# EAGLE schematic Resistor_Resistor (EAGLE 8.3.0), part 27 of 43
## Parts (continued)
R37218  10K  RESISTOR_0201  [0201]
R37219  10K  RESISTOR_0201  [0201]
R37220  10K  RESISTOR_0201  [0201]
R37221  10K  RESISTOR_0201  [0201]
R37222  10K  RESISTOR_0201  [0201]
R37223  10K  RESISTOR_0201  [0201]
R37224  10K  RESISTOR_0201  [0201]
R37225  10K  RESISTOR_0201  [0201]
R37226  10K  RESISTOR_0201  [0201]
R37227  10K  RESISTOR_0201  [0201]
R37228  10K  RESISTOR_0201  [0201]
R37229  10K  RESISTOR_0201  [0201]
R37230  10K  RESISTOR_0201  [0201]
R37231  10K  RESISTOR_0201  [0201]
R37232  10K  RESISTOR_0201  [0201]
R37233  10K  RESISTOR_0201  [0201]
R37234  10K  RESISTOR_0201  [0201]
R37235  10K  RESISTOR_0201  [0201]
R37236  10K  RESISTOR_0201  [0201]
R37237  10K  RESISTOR_0201  [0201]
R37238  10K  RESISTOR_0201  [0201]
R37239  10K  RESISTOR_0201  [0201]
R37240  10K  RESISTOR_0201  [0201]
R37241  10K  RESISTOR_0201  [0201]
R37242  10K  RESISTOR_0201  [0201]
R37243  10K  RESISTOR_0201  [0201]
R37244  10K  RESISTOR_0201  [0201]
R37245  10K  RESISTOR_0201  [0201]
R37246  10K  RESISTOR_0201  [0201]
R37247  10K  RESISTOR_0201  [0201]
R37248  10K  RESISTOR_0201  [0201]
R37249  10K  RESISTOR_0201  [0201]
R37250  10K  RESISTOR_0201  [0201]
R37251  10K  RESISTOR_0201  [0201]
R37252  10K  RESISTOR_0201  [0201]
R37253  10K  RESISTOR_0201  [0201]
R37254  10K  RESISTOR_0201  [0201]
R37255  10K  RESISTOR_0201  [0201]
R37256  10K  RESISTOR_0201  [0201]
R37257  10K  RESISTOR_0201  [0201]
R37258  10K  RESISTOR_0201  [0201]
R37259  10K  RESISTOR_0201  [0201]
R37260  10K  RESISTOR_0201  [0201]
R37261  10K  RESISTOR_0201  [0201]
R37262  10K  RESISTOR_0201  [0201]
R37263  10K  RESISTOR_0201  [0201]
R37264  10K  RESISTOR_0201  [0201]
R37265  10K  RESISTOR_0201  [0201]
R37266  10K  RESISTOR_0201  [0201]
R37267  10K  RESISTOR_0201  [0201]
R37268  10K  RESISTOR_0201  [0201]
R37269  10K  RESISTOR_0201  [0201]
R37270  10K  RESISTOR_0201  [0201]
R37271  10K  RESISTOR_0201  [0201]
R37272  10K  RESISTOR_0201  [0201]
R37273  10K  RESISTOR_0201  [0201]
R37274  10K  RESISTOR_0201  [0201]
R37275  10K  RESISTOR_0201  [0201]
R37276  10K  RESISTOR_0201  [0201]
R37277  10K  RESISTOR_0201  [0201]
R37278  10K  RESISTOR_0201  [0201]
R37279  10K  RESISTOR_0201  [0201]
R37280  10K  RESISTOR_0201  [0201]
R37281  10K  RESISTOR_0201  [0201]
R37282  10K  RESISTOR_0201  [0201]
R37283  10K  RESISTOR_0201  [0201]
R37284  10K  RESISTOR_0201  [0201]
R37285  10K  RESISTOR_0201  [0201]
R37286  10K  RESISTOR_0201  [0201]
R37287  10K  RESISTOR_0201  [0201]
R37288  10K  RESISTOR_0201  [0201]
R37289  10K  RESISTOR_0201  [0201]
R37290  10K  RESISTOR_0201  [0201]
R37291  10K  RESISTOR_0201  [0201]
R37292  10K  RESISTOR_0201  [0201]
R37293  10K  RESISTOR_0201  [0201]
R37294  10K  RESISTOR_0201  [0201]
R37295  10K  RESISTOR_0201  [0201]
R37296  10K  RESISTOR_0201  [0201]
R37297  10K  RESISTOR_0201  [0201]
R37298  10K  RESISTOR_0201  [0201]
R37299  10K  RESISTOR_0201  [0201]
R37300  10K  RESISTOR_0201  [0201]
R37301  10K  RESISTOR_0201  [0201]
R37302  10K  RESISTOR_0201  [0201]
R37303  10K  RESISTOR_0201  [0201]
R37304  10K  RESISTOR_0201  [0201]
R37305  10K  RESISTOR_0201  [0201]
R37306  10K  RESISTOR_0201  [0201]
R37307  10K  RESISTOR_0201  [0201]
R37308  10K  RESISTOR_0201  [0201]
R37309  10K  RESISTOR_0201  [0201]
R37310  10K  RESISTOR_0201  [0201]
R37311  10K  RESISTOR_0201  [0201]
R37312  10K  RESISTOR_0201  [0201]
R37313  10K  RESISTOR_0201  [0201]
R37314  10K  RESISTOR_0201  [0201]
R37315  10K  RESISTOR_0201  [0201]
R37316  10K  RESISTOR_0201  [0201]
R37317  10K  RESISTOR_0201  [0201]
R37318  10K  RESISTOR_0201  [0201]
R37319  10K  RESISTOR_0201  [0201]
R37320  10K  RESISTOR_0201  [0201]
R37321  10K  RESISTOR_0201  [0201]
R37322  10K  RESISTOR_0201  [0201]
R37323  10K  RESISTOR_0201  [0201]
R37324  10K  RESISTOR_0201  [0201]
R37325  10K  RESISTOR_0201  [0201]
R37326  10K  RESISTOR_0201  [0201]
R37327  10K  RESISTOR_0201  [0201]
R37328  10K  RESISTOR_0201  [0201]
R37329  10K  RESISTOR_0201  [0201]
R37330  10K  RESISTOR_0201  [0201]
R37331  10K  RESISTOR_0201  [0201]
R37332  10K  RESISTOR_0201  [0201]
R37333  10K  RESISTOR_0201  [0201]
R37334  10K  RESISTOR_0201  [0201]
R37335  10K  RESISTOR_0201  [0201]
R37336  10K  RESISTOR_0201  [0201]
R37337  10K  RESISTOR_0201  [0201]
R37338  10K  RESISTOR_0201  [0201]
R37339  10K  RESISTOR_0201  [0201]
R37340  10K  RESISTOR_0201  [0201]
R37341  10K  RESISTOR_0201  [0201]
R37342  10K  RESISTOR_0201  [0201]
R37343  10K  RESISTOR_0201  [0201]
R37344  10K  RESISTOR_0201  [0201]
R37345  10K  RESISTOR_0201  [0201]
R37346  10K  RESISTOR_0201  [0201]
R37347  10K  RESISTOR_0201  [0201]
R37348  10K  RESISTOR_0201  [0201]
R37349  10K  RESISTOR_0201  [0201]
R37350  10K  RESISTOR_0201  [0201]
R37351  10K  RESISTOR_0201  [0201]
R37352  10K  RESISTOR_0201  [0201]
R37353  10K  RESISTOR_0201  [0201]
R37354  10K  RESISTOR_0201  [0201]
R37355  10K  RESISTOR_0201  [0201]
R37356  10K  RESISTOR_0201  [0201]
R37357  10K  RESISTOR_0201  [0201]
R37358  10K  RESISTOR_0201  [0201]
R37359  10K  RESISTOR_0201  [0201]
R37360  10K  RESISTOR_0201  [0201]
R37361  10K  RESISTOR_0201  [0201]
R37362  10K  RESISTOR_0201  [0201]
R37363  10K  RESISTOR_0201  [0201]
R37364  10K  RESISTOR_0201  [0201]
R37365  10K  RESISTOR_0201  [0201]
R37366  10K  RESISTOR_0201  [0201]
R37367  10K  RESISTOR_0201  [0201]
R37368  10K  RESISTOR_0201  [0201]
R37369  10K  RESISTOR_0201  [0201]
R37370  10K  RESISTOR_0201  [0201]
R37371  10K  RESISTOR_0201  [0201]
R37372  10K  RESISTOR_0201  [0201]
R37373  10K  RESISTOR_0201  [0201]
R37374  10K  RESISTOR_0201  [0201]
R37375  10K  RESISTOR_0201  [0201]
R37376  10K  RESISTOR_0201  [0201]
R37377  10K  RESISTOR_0201  [0201]
R37378  10K  RESISTOR_0201  [0201]
R37379  10K  RESISTOR_0201  [0201]
R37380  10K  RESISTOR_0201  [0201]
R37381  10K  RESISTOR_0201  [0201]
R37382  10K  RESISTOR_0201  [0201]
R37383  10K  RESISTOR_0201  [0201]
R37384  10K  RESISTOR_0201  [0201]
R37385  10K  RESISTOR_0201  [0201]
R37386  10K  RESISTOR_0201  [0201]
R37387  10K  RESISTOR_0201  [0201]
R37388  10K  RESISTOR_0201  [0201]
R37389  10K  RESISTOR_0201  [0201]
R37390  10K  RESISTOR_0201  [0201]
R37391  10K  RESISTOR_0201  [0201]
R37392  10K  RESISTOR_0201  [0201]
R37393  10K  RESISTOR_0201  [0201]
R37394  10K  RESISTOR_0201  [0201]
R37395  10K  RESISTOR_0201  [0201]
R37396  10K  RESISTOR_0201  [0201]
R37397  10K  RESISTOR_0201  [0201]
R37398  10K  RESISTOR_0201  [0201]
R37399  10K  RESISTOR_0201  [0201]
R37400  10K  RESISTOR_0201  [0201]
R37401  10K  RESISTOR_0201  [0201]
R37402  10K  RESISTOR_0201  [0201]
R37403  10K  RESISTOR_0201  [0201]
R37404  10K  RESISTOR_0201  [0201]
R37405  10K  RESISTOR_0201  [0201]
R37406  10K  RESISTOR_0201  [0201]
R37407  10K  RESISTOR_0201  [0201]
R37408  10K  RESISTOR_0201  [0201]
R37409  10K  RESISTOR_0201  [0201]
R37410  10K  RESISTOR_0201  [0201]
R37411  10K  RESISTOR_0201  [0201]
R37412  10K  RESISTOR_0201  [0201]
R37413  10K  RESISTOR_0201  [0201]
R37414  10K  RESISTOR_0201  [0201]
R37415  10K  RESISTOR_0201  [0201]
R37416  10K  RESISTOR_0201  [0201]
R37417  10K  RESISTOR_0201  [0201]
R37418  10K  RESISTOR_0201  [0201]
R37419  10K  RESISTOR_0201  [0201]
R37420  10K  RESISTOR_0201  [0201]
R37421  10K  RESISTOR_0201  [0201]
R37422  10K  RESISTOR_0201  [0201]
R37423  10K  RESISTOR_0201  [0201]
R37424  10K  RESISTOR_0201  [0201]
R37425  10K  RESISTOR_0201  [0201]
R37426  10K  RESISTOR_0201  [0201]
R37427  10K  RESISTOR_0201  [0201]
R37428  10K  RESISTOR_0201  [0201]
R37429  10K  RESISTOR_0201  [0201]
R37430  10K  RESISTOR_0201  [0201]
R37431  10K  RESISTOR_0201  [0201]
R37432  10K  RESISTOR_0201  [0201]
R37433  10K  RESISTOR_0201  [0201]
R37434  10K  RESISTOR_0201  [0201]
R37435  10K  RESISTOR_0201  [0201]
R37436  10K  RESISTOR_0201  [0201]
R37437  10K  RESISTOR_0201  [0201]
R37438  10K  RESISTOR_0201  [0201]
R37439  10K  RESISTOR_0201  [0201]
R37440  10K  RESISTOR_0201  [0201]
R37441  10K  RESISTOR_0201  [0201]
R37442  10K  RESISTOR_0201  [0201]
R37443  10K  RESISTOR_0201  [0201]
R37444  10K  RESISTOR_0201  [0201]
R37445  10K  RESISTOR_0201  [0201]
R37446  10K  RESISTOR_0201  [0201]
R37447  10K  RESISTOR_0201  [0201]
R37448  10K  RESISTOR_0201  [0201]
R37449  10K  RESISTOR_0201  [0201]
R37450  10K  RESISTOR_0201  [0201]
R37451  10K  RESISTOR_0201  [0201]
R37452  10K  RESISTOR_0201  [0201]
R37453  10K  RESISTOR_0201  [0201]
R37454  10K  RESISTOR_0201  [0201]
R37455  10K  RESISTOR_0201  [0201]
R37456  10K  RESISTOR_0201  [0201]
R37457  10K  RESISTOR_0201  [0201]
R37458  10K  RESISTOR_0201  [0201]
R37459  10K  RESISTOR_0201  [0201]
R37460  10K  RESISTOR_0201  [0201]
R37461  10K  RESISTOR_0201  [0201]
R37462  10K  RESISTOR_0201  [0201]
R37463  10K  RESISTOR_0201  [0201]
R37464  10K  RESISTOR_0201  [0201]
R37465  10K  RESISTOR_0201  [0201]
R37466  10K  RESISTOR_0201  [0201]
R37467  10K  RESISTOR_0201  [0201]
R37468  10K  RESISTOR_0201  [0201]
R37469  10K  RESISTOR_0201  [0201]
R37470  10K  RESISTOR_0201  [0201]
R37471  10K  RESISTOR_0201  [0201]
R37472  10K  RESISTOR_0201  [0201]
R37473  10K  RESISTOR_0201  [0201]
R37474  10K  RESISTOR_0201  [0201]
R37475  10K  RESISTOR_0201  [0201]
R37476  10K  RESISTOR_0201  [0201]
R37477  10K  RESISTOR_0201  [0201]
R37478  10K  RESISTOR_0201  [0201]
R37479  10K  RESISTOR_0201  [0201]
R37480  10K  RESISTOR_0201  [0201]
R37481  10K  RESISTOR_0201  [0201]
R37482  10K  RESISTOR_0201  [0201]
R37483  10K  RESISTOR_0201  [0201]
R37484  10K  RESISTOR_0201  [0201]
R37485  10K  RESISTOR_0201  [0201]
R37486  10K  RESISTOR_0201  [0201]
R37487  10K  RESISTOR_0201  [0201]
R37488  10K  RESISTOR_0201  [0201]
R37489  10K  RESISTOR_0201  [0201]
R37490  10K  RESISTOR_0201  [0201]
R37491  10K  RESISTOR_0201  [0201]
R37492  10K  RESISTOR_0201  [0201]
R37493  10K  RESISTOR_0201  [0201]
R37494  10K  RESISTOR_0201  [0201]
R37495  10K  RESISTOR_0201  [0201]
R37496  10K  RESISTOR_0201  [0201]
R37497  10K  RESISTOR_0201  [0201]
R37498  10K  RESISTOR_0201  [0201]
R37499  10K  RESISTOR_0201  [0201]
R37500  10K  RESISTOR_0201  [0201]
R37501  10K  RESISTOR_0201  [0201]
R37502  10K  RESISTOR_0201  [0201]
R37503  10K  RESISTOR_0201  [0201]
R37504  10K  RESISTOR_0201  [0201]
R37505  10K  RESISTOR_0201  [0201]
R37506  10K  RESISTOR_0201  [0201]
R37507  10K  RESISTOR_0201  [0201]
R37508  10K  RESISTOR_0201  [0201]
R37509  10K  RESISTOR_0201  [0201]
R37510  10K  RESISTOR_0201  [0201]
R37511  10K  RESISTOR_0201  [0201]
R37512  10K  RESISTOR_0201  [0201]
R37513  10K  RESISTOR_0201  [0201]
R37514  10K  RESISTOR_0201  [0201]
R37515  10K  RESISTOR_0201  [0201]
R37516  10K  RESISTOR_0201  [0201]
R37517  10K  RESISTOR_0201  [0201]
R37518  10K  RESISTOR_0201  [0201]
R37519  10K  RESISTOR_0201  [0201]
R37520  10K  RESISTOR_0201  [0201]
R37521  10K  RESISTOR_0201  [0201]
R37522  10K  RESISTOR_0201  [0201]
R37523  10K  RESISTOR_0201  [0201]
R37524  10K  RESISTOR_0201  [0201]
R37525  10K  RESISTOR_0201  [0201]
R37526  10K  RESISTOR_0201  [0201]
R37527  10K  RESISTOR_0201  [0201]
R37528  10K  RESISTOR_0201  [0201]
R37529  10K  RESISTOR_0201  [0201]
R37530  10K  RESISTOR_0201  [0201]
R37531  10K  RESISTOR_0201  [0201]
R37532  10K  RESISTOR_0201  [0201]
R37533  10K  RESISTOR_0201  [0201]
R37534  10K  RESISTOR_0201  [0201]
R37535  10K  RESISTOR_0201  [0201]
R37536  10K  RESISTOR_0201  [0201]
R37537  10K  RESISTOR_0201  [0201]
R37538  10K  RESISTOR_0201  [0201]
R37539  10K  RESISTOR_0201  [0201]
R37540  10K  RESISTOR_0201  [0201]
R37541  10K  RESISTOR_0201  [0201]
R37542  10K  RESISTOR_0201  [0201]
R37543  10K  RESISTOR_0201  [0201]
R37544  10K  RESISTOR_0201  [0201]
R37545  10K  RESISTOR_0201  [0201]
R37546  10K  RESISTOR_0201  [0201]
R37547  10K  RESISTOR_0201  [0201]
R37548  10K  RESISTOR_0201  [0201]
R37549  10K  RESISTOR_0201  [0201]
R37550  10K  RESISTOR_0201  [0201]
R37551  10K  RESISTOR_0201  [0201]
R37552  10K  RESISTOR_0201  [0201]
R37553  10K  RESISTOR_0201  [0201]
R37554  10K  RESISTOR_0201  [0201]
R37555  10K  RESISTOR_0201  [0201]
R37556  10K  RESISTOR_0201  [0201]
R37557  10K  RESISTOR_0201  [0201]
R37558  10K  RESISTOR_0201  [0201]
R37559  10K  RESISTOR_0201  [0201]
R37560  10K  RESISTOR_0201  [0201]
R37561  10K  RESISTOR_0201  [0201]
R37562  10K  RESISTOR_0201  [0201]
R37563  10K  RESISTOR_0201  [0201]
R37564  10K  RESISTOR_0201  [0201]
R37565  10K  RESISTOR_0201  [0201]
R37566  10K  RESISTOR_0201  [0201]
R37567  10K  RESISTOR_0201  [0201]
R37568  10K  RESISTOR_0201  [0201]
R37569  10K  RESISTOR_0201  [0201]
R37570  10K  RESISTOR_0201  [0201]
R37571  10K  RESISTOR_0201  [0201]
R37572  10K  RESISTOR_0201  [0201]
R37573  10K  RESISTOR_0201  [0201]
R37574  10K  RESISTOR_0201  [0201]
R37575  10K  RESISTOR_0201  [0201]
R37576  10K  RESISTOR_0201  [0201]
R37577  10K  RESISTOR_0201  [0201]
R37578  10K  RESISTOR_0201  [0201]
R37579  10K  RESISTOR_0201  [0201]
R37580  10K  RESISTOR_0201  [0201]
R37581  10K  RESISTOR_0201  [0201]
R37582  10K  RESISTOR_0201  [0201]
R37583  10K  RESISTOR_0201  [0201]
R37584  10K  RESISTOR_0201  [0201]
R37585  10K  RESISTOR_0201  [0201]
R37586  10K  RESISTOR_0201  [0201]
R37587  10K  RESISTOR_0201  [0201]
R37588  10K  RESISTOR_0201  [0201]
R37589  10K  RESISTOR_0201  [0201]
R37590  10K  RESISTOR_0201  [0201]
R37591  10K  RESISTOR_0201  [0201]
R37592  10K  RESISTOR_0201  [0201]
R37593  10K  RESISTOR_0201  [0201]
R37594  10K  RESISTOR_0201  [0201]
R37595  10K  RESISTOR_0201  [0201]
R37596  10K  RESISTOR_0201  [0201]
R37597  10K  RESISTOR_0201  [0201]
R37598  10K  RESISTOR_0201  [0201]
R37599  10K  RESISTOR_0201  [0201]
R37600  10K  RESISTOR_0201  [0201]
R37601  10K  RESISTOR_0201  [0201]
R37602  10K  RESISTOR_0201  [0201]
R37603  10K  RESISTOR_0201  [0201]
R37604  10K  RESISTOR_0201  [0201]
R37605  10K  RESISTOR_0201  [0201]
R37606  10K  RESISTOR_0201  [0201]
R37607  10K  RESISTOR_0201  [0201]
R37608  10K  RESISTOR_0201  [0201]
R37609  10K  RESISTOR_0201  [0201]
R37610  10K  RESISTOR_0201  [0201]
R37611  10K  RESISTOR_0201  [0201]
R37612  10K  RESISTOR_0201  [0201]
R37613  10K  RESISTOR_0201  [0201]
R37614  10K  RESISTOR_0201  [0201]
R37615  10K  RESISTOR_0201  [0201]
R37616  10K  RESISTOR_0201  [0201]
R37617  10K  RESISTOR_0201  [0201]
R37618  10K  RESISTOR_0201  [0201]
R37619  10K  RESISTOR_0201  [0201]
R37620  10K  RESISTOR_0201  [0201]
R37621  10K  RESISTOR_0201  [0201]
R37622  10K  RESISTOR_0201  [0201]
R37623  10K  RESISTOR_0201  [0201]
R37624  10K  RESISTOR_0201  [0201]
R37625  10K  RESISTOR_0201  [0201]
R37626  10K  RESISTOR_0201  [0201]
R37627  10K  RESISTOR_0201  [0201]
R37628  10K  RESISTOR_0201  [0201]
R37629  10K  RESISTOR_0201  [0201]
R37630  10K  RESISTOR_0201  [0201]
R37631  10K  RESISTOR_0201  [0201]
R37632  10K  RESISTOR_0201  [0201]
R37633  10K  RESISTOR_0201  [0201]
R37634  10K  RESISTOR_0201  [0201]
R37635  10K  RESISTOR_0201  [0201]
R37636  10K  RESISTOR_0201  [0201]
R37637  10K  RESISTOR_0201  [0201]
R37638  10K  RESISTOR_0201  [0201]
R37639  10K  RESISTOR_0201  [0201]
R37640  10K  RESISTOR_0201  [0201]
R37641  10K  RESISTOR_0201  [0201]
R37642  10K  RESISTOR_0201  [0201]
R37643  10K  RESISTOR_0201  [0201]
R37644  10K  RESISTOR_0201  [0201]
R37645  10K  RESISTOR_0201  [0201]
R37646  10K  RESISTOR_0201  [0201]
R37647  10K  RESISTOR_0201  [0201]
R37648  10K  RESISTOR_0201  [0201]
R37649  10K  RESISTOR_0201  [0201]
R37650  10K  RESISTOR_0201  [0201]
R37651  10K  RESISTOR_0201  [0201]
R37652  10K  RESISTOR_0201  [0201]
R37653  10K  RESISTOR_0201  [0201]
R37654  10K  RESISTOR_0201  [0201]
R37655  10K  RESISTOR_0201  [0201]
R37656  10K  RESISTOR_0201  [0201]
R37657  10K  RESISTOR_0201  [0201]
R37658  10K  RESISTOR_0201  [0201]
R37659  10K  RESISTOR_0201  [0201]
R37660  10K  RESISTOR_0201  [0201]
R37661  10K  RESISTOR_0201  [0201]
R37662  10K  RESISTOR_0201  [0201]
R37663  10K  RESISTOR_0201  [0201]
R37664  10K  RESISTOR_0201  [0201]
R37665  10K  RESISTOR_0201  [0201]
R37666  10K  RESISTOR_0201  [0201]
R37667  10K  RESISTOR_0201  [0201]
R37668  10K  RESISTOR_0201  [0201]
R37669  10K  RESISTOR_0201  [0201]
R37670  10K  RESISTOR_0201  [0201]
R37671  10K  RESISTOR_0201  [0201]
R37672  10K  RESISTOR_0201  [0201]
R37673  10K  RESISTOR_0201  [0201]
R37674  10K  RESISTOR_0201  [0201]
R37675  10K  RESISTOR_0201  [0201]
R37676  10K  RESISTOR_0201  [0201]
R37677  10K  RESISTOR_0201  [0201]
R37678  10K  RESISTOR_0201  [0201]
R37679  10K  RESISTOR_0201  [0201]
R37680  10K  RESISTOR_0201  [0201]
R37681  10K  RESISTOR_0201  [0201]
R37682  10K  RESISTOR_0201  [0201]
R37683  10K  RESISTOR_0201  [0201]
R37684  10K  RESISTOR_0201  [0201]
R37685  10K  RESISTOR_0201  [0201]
R37686  10K  RESISTOR_0201  [0201]
R37687  10K  RESISTOR_0201  [0201]
R37688  10K  RESISTOR_0201  [0201]
R37689  10K  RESISTOR_0201  [0201]
R37690  10K  RESISTOR_0201  [0201]
R37691  10K  RESISTOR_0201  [0201]
R37692  10K  RESISTOR_0201  [0201]
R37693  10K  RESISTOR_0201  [0201]
R37694  10K  RESISTOR_0201  [0201]
R37695  10K  RESISTOR_0201  [0201]
R37696  10K  RESISTOR_0201  [0201]
R37697  10K  RESISTOR_0201  [0201]
R37698  10K  RESISTOR_0201  [0201]
R37699  10K  RESISTOR_0201  [0201]
R37700  10K  RESISTOR_0201  [0201]
R37701  10K  RESISTOR_0201  [0201]
R37702  10K  RESISTOR_0201  [0201]
R37703  10K  RESISTOR_0201  [0201]
R37704  10K  RESISTOR_0201  [0201]
R37705  10K  RESISTOR_0201  [0201]
R37706  10K  RESISTOR_0201  [0201]
R37707  10K  RESISTOR_0201  [0201]
R37708  10K  RESISTOR_0201  [0201]
R37709  10K  RESISTOR_0201  [0201]
R37710  10K  RESISTOR_0201  [0201]
R37711  10K  RESISTOR_0201  [0201]
R37712  10K  RESISTOR_0201  [0201]
R37713  10K  RESISTOR_0201  [0201]
R37714  10K  RESISTOR_0201  [0201]
R37715  10K  RESISTOR_0201  [0201]
R37716  10K  RESISTOR_0201  [0201]
R37717  10K  RESISTOR_0201  [0201]
R37718  10K  RESISTOR_0201  [0201]
R37719  10K  RESISTOR_0201  [0201]
R37720  10K  RESISTOR_0201  [0201]
R37721  10K  RESISTOR_0201  [0201]
R37722  10K  RESISTOR_0201  [0201]
R37723  10K  RESISTOR_0201  [0201]
R37724  10K  RESISTOR_0201  [0201]
R37725  10K  RESISTOR_0201  [0201]
R37726  10K  RESISTOR_0201  [0201]
R37727  10K  RESISTOR_0201  [0201]
R37728  10K  RESISTOR_0201  [0201]
R37729  10K  RESISTOR_0201  [0201]
R37730  10K  RESISTOR_0201  [0201]
R37731  10K  RESISTOR_0201  [0201]
R37732  10K  RESISTOR_0201  [0201]
R37733  10K  RESISTOR_0201  [0201]
R37734  10K  RESISTOR_0201  [0201]
R37735  10K  RESISTOR_0201  [0201]
R37736  10K  RESISTOR_0201  [0201]
R37737  10K  RESISTOR_0201  [0201]
R37738  10K  RESISTOR_0201  [0201]
R37739  10K  RESISTOR_0201  [0201]
R37740  10K  RESISTOR_0201  [0201]
R37741  10K  RESISTOR_0201  [0201]
R37742  10K  RESISTOR_0201  [0201]
R37743  10K  RESISTOR_0201  [0201]
R37744  10K  RESISTOR_0201  [0201]
R37745  10K  RESISTOR_0201  [0201]
R37746  10K  RESISTOR_0201  [0201]
R37747  10K  RESISTOR_0201  [0201]
R37748  10K  RESISTOR_0201  [0201]
R37749  10K  RESISTOR_0201  [0201]
R37750  10K  RESISTOR_0201  [0201]
R37751  10K  RESISTOR_0201  [0201]
R37752  10K  RESISTOR_0201  [0201]
R37753  10K  RESISTOR_0201  [0201]
R37754  10K  RESISTOR_0201  [0201]
R37755  10K  RESISTOR_0201  [0201]
R37756  10K  RESISTOR_0201  [0201]
R37757  10K  RESISTOR_0201  [0201]
R37758  10K  RESISTOR_0201  [0201]
R37759  10K  RESISTOR_0201  [0201]
R37760  10K  RESISTOR_0201  [0201]
R37761  10K  RESISTOR_0201  [0201]
R37762  10K  RESISTOR_0201  [0201]
R37763  10K  RESISTOR_0201  [0201]
R37764  10K  RESISTOR_0201  [0201]
R37765  10K  RESISTOR_0201  [0201]
R37766  10K  RESISTOR_0201  [0201]
R37767  10K  RESISTOR_0201  [0201]
R37768  10K  RESISTOR_0201  [0201]
R37769  10K  RESISTOR_0201  [0201]
R37770  10K  RESISTOR_0201  [0201]
R37771  10K  RESISTOR_0201  [0201]
R37772  10K  RESISTOR_0201  [0201]
R37773  10K  RESISTOR_0201  [0201]
R37774  10K  RESISTOR_0201  [0201]
R37775  10K  RESISTOR_0201  [0201]
R37776  10K  RESISTOR_0201  [0201]
R37777  10K  RESISTOR_0201  [0201]
R37778  10K  RESISTOR_0201  [0201]
R37779  10K  RESISTOR_0201  [0201]
R37780  10K  RESISTOR_0201  [0201]
R37781  10K  RESISTOR_0201  [0201]
R37782  10K  RESISTOR_0201  [0201]
R37783  10K  RESISTOR_0201  [0201]
R37784  10K  RESISTOR_0201  [0201]
R37785  10K  RESISTOR_0201  [0201]
R37786  10K  RESISTOR_0201  [0201]
R37787  10K  RESISTOR_0201  [0201]
R37788  10K  RESISTOR_0201  [0201]
R37789  10K  RESISTOR_0201  [0201]
R37790  10K  RESISTOR_0201  [0201]
R37791  10K  RESISTOR_0201  [0201]
R37792  10K  RESISTOR_0201  [0201]
R37793  10K  RESISTOR_0201  [0201]
R37794  10K  RESISTOR_0201  [0201]
R37795  10K  RESISTOR_0201  [0201]
R37796  10K  RESISTOR_0201  [0201]
R37797  10K  RESISTOR_0201  [0201]
R37798  10K  RESISTOR_0201  [0201]
R37799  10K  RESISTOR_0201  [0201]
R37800  10K  RESISTOR_0201  [0201]
R37801  10K  RESISTOR_0201  [0201]
R37802  10K  RESISTOR_0201  [0201]
R37803  10K  RESISTOR_0201  [0201]
R37804  10K  RESISTOR_0201  [0201]
R37805  10K  RESISTOR_0201  [0201]
R37806  10K  RESISTOR_0201  [0201]
R37807  10K  RESISTOR_0201  [0201]
R37808  10K  RESISTOR_0201  [0201]
R37809  10K  RESISTOR_0201  [0201]
R37810  10K  RESISTOR_0201  [0201]
R37811  10K  RESISTOR_0201  [0201]
R37812  10K  RESISTOR_0201  [0201]
R37813  10K  RESISTOR_0201  [0201]
R37814  10K  RESISTOR_0201  [0201]
R37815  10K  RESISTOR_0201  [0201]
R37816  10K  RESISTOR_0201  [0201]
R37817  10K  RESISTOR_0201  [0201]
R37818  10K  RESISTOR_0201  [0201]
R37819  10K  RESISTOR_0201  [0201]
R37820  10K  RESISTOR_0201  [0201]
R37821  10K  RESISTOR_0201  [0201]
R37822  10K  RESISTOR_0201  [0201]
R37823  10K  RESISTOR_0201  [0201]
R37824  10K  RESISTOR_0201  [0201]
R37825  10K  RESISTOR_0201  [0201]
R37826  10K  RESISTOR_0201  [0201]
R37827  10K  RESISTOR_0201  [0201]
R37828  10K  RESISTOR_0201  [0201]
R37829  10K  RESISTOR_0201  [0201]
R37830  10K  RESISTOR_0201  [0201]
R37831  10K  RESISTOR_0201  [0201]
R37832  10K  RESISTOR_0201  [0201]
R37833  10K  RESISTOR_0201  [0201]
R37834  10K  RESISTOR_0201  [0201]
R37835  10K  RESISTOR_0201  [0201]
R37836  10K  RESISTOR_0201  [0201]
R37837  10K  RESISTOR_0201  [0201]
R37838  10K  RESISTOR_0201  [0201]
R37839  10K  RESISTOR_0201  [0201]
R37840  10K  RESISTOR_0201  [0201]
R37841  10K  RESISTOR_0201  [0201]
R37842  10K  RESISTOR_0201  [0201]
R37843  10K  RESISTOR_0201  [0201]
R37844  10K  RESISTOR_0201  [0201]
R37845  10K  RESISTOR_0201  [0201]
R37846  10K  RESISTOR_0201  [0201]
R37847  10K  RESISTOR_0201  [0201]
R37848  10K  RESISTOR_0201  [0201]
R37849  10K  RESISTOR_0201  [0201]
R37850  10K  RESISTOR_0201  [0201]
R37851  10K  RESISTOR_0201  [0201]
R37852  10K  RESISTOR_0201  [0201]
R37853  10K  RESISTOR_0201  [0201]
R37854  10K  RESISTOR_0201  [0201]
R37855  10K  RESISTOR_0201  [0201]
R37856  10K  RESISTOR_0201  [0201]
R37857  10K  RESISTOR_0201  [0201]
R37858  10K  RESISTOR_0201  [0201]
R37859  10K  RESISTOR_0201  [0201]
R37860  10K  RESISTOR_0201  [0201]
R37861  10K  RESISTOR_0201  [0201]
R37862  10K  RESISTOR_0201  [0201]
R37863  10K  RESISTOR_0201  [0201]
R37864  10K  RESISTOR_0201  [0201]
R37865  10K  RESISTOR_0201  [0201]
R37866  10K  RESISTOR_0201  [0201]
R37867  10K  RESISTOR_0201  [0201]
R37868  10K  RESISTOR_0201  [0201]
R37869  10K  RESISTOR_0201  [0201]
R37870  10K  RESISTOR_0201  [0201]
R37871  10K  RESISTOR_0201  [0201]
R37872  10K  RESISTOR_0201  [0201]
R37873  10K  RESISTOR_0201  [0201]
R37874  10K  RESISTOR_0201  [0201]
R37875  10K  RESISTOR_0201  [0201]
R37876  10K  RESISTOR_0201  [0201]
R37877  10K  RESISTOR_0201  [0201]
R37878  10K  RESISTOR_0201  [0201]
R37879  10K  RESISTOR_0201  [0201]
R37880  10K  RESISTOR_0201  [0201]
R37881  10K  RESISTOR_0201  [0201]
R37882  10K  RESISTOR_0201  [0201]
R37883  10K  RESISTOR_0201  [0201]
R37884  10K  RESISTOR_0201  [0201]
R37885  10K  RESISTOR_0201  [0201]
R37886  10K  RESISTOR_0201  [0201]
R37887  10K  RESISTOR_0201  [0201]
R37888  10K  RESISTOR_0201  [0201]
R37889  10K  RESISTOR_0201  [0201]
R37890  10K  RESISTOR_0201  [0201]
R37891  10K  RESISTOR_0201  [0201]
R37892  10K  RESISTOR_0201  [0201]
R37893  10K  RESISTOR_0201  [0201]
R37894  10K  RESISTOR_0201  [0201]
R37895  10K  RESISTOR_0201  [0201]
R37896  10K  RESISTOR_0201  [0201]
R37897  10K  RESISTOR_0201  [0201]
R37898  10K  RESISTOR_0201  [0201]
R37899  10K  RESISTOR_0201  [0201]
R37900  10K  RESISTOR_0201  [0201]
R37901  10K  RESISTOR_0201  [0201]
R37902  10K  RESISTOR_0201  [0201]
R37903  10K  RESISTOR_0201  [0201]
R37904  10K  RESISTOR_0201  [0201]
R37905  10K  RESISTOR_0201  [0201]
R37906  10K  RESISTOR_0201  [0201]
R37907  10K  RESISTOR_0201  [0201]
R37908  10K  RESISTOR_0201  [0201]
R37909  10K  RESISTOR_0201  [0201]
R37910  10K  RESISTOR_0201  [0201]
R37911  10K  RESISTOR_0201  [0201]
R37912  10K  RESISTOR_0201  [0201]
R37913  10K  RESISTOR_0201  [0201]
R37914  10K  RESISTOR_0201  [0201]
R37915  10K  RESISTOR_0201  [0201]
R37916  10K  RESISTOR_0201  [0201]
R37917  10K  RESISTOR_0201  [0201]
R37918  10K  RESISTOR_0201  [0201]
R37919  10K  RESISTOR_0201  [0201]
R37920  10K  RESISTOR_0201  [0201]
R37921  10K  RESISTOR_0201  [0201]
R37922  10K  RESISTOR_0201  [0201]
R37923  10K  RESISTOR_0201  [0201]
R37924  10K  RESISTOR_0201  [0201]
R37925  10K  RESISTOR_0201  [0201]
R37926  10K  RESISTOR_0201  [0201]
R37927  10K  RESISTOR_0201  [0201]
R37928  10K  RESISTOR_0201  [0201]
R37929  10K  RESISTOR_0201  [0201]
R37930  10K  RESISTOR_0201  [0201]
R37931  10K  RESISTOR_0201  [0201]
R37932  10K  RESISTOR_0201  [0201]
R37933  10K  RESISTOR_0201  [0201]
R37934  10K  RESISTOR_0201  [0201]
R37935  10K  RESISTOR_0201  [0201]
R37936  10K  RESISTOR_0201  [0201]
R37937  10K  RESISTOR_0201  [0201]
R37938  10K  RESISTOR_0201  [0201]
R37939  10K  RESISTOR_0201  [0201]
R37940  10K  RESISTOR_0201  [0201]
R37941  10K  RESISTOR_0201  [0201]
R37942  10K  RESISTOR_0201  [0201]
R37943  10K  RESISTOR_0201  [0201]
R37944  10K  RESISTOR_0201  [0201]
R37945  10K  RESISTOR_0201  [0201]
R37946  10K  RESISTOR_0201  [0201]
R37947  10K  RESISTOR_0201  [0201]
R37948  10K  RESISTOR_0201  [0201]
R37949  10K  RESISTOR_0201  [0201]
R37950  10K  RESISTOR_0201  [0201]
R37951  10K  RESISTOR_0201  [0201]
R37952  10K  RESISTOR_0201  [0201]
R37953  10K  RESISTOR_0201  [0201]
R37954  10K  RESISTOR_0201  [0201]
R37955  10K  RESISTOR_0201  [0201]
R37956  10K  RESISTOR_0201  [0201]
R37957  10K  RESISTOR_0201  [0201]
R37958  10K  RESISTOR_0201  [0201]
R37959  10K  RESISTOR_0201  [0201]
R37960  10K  RESISTOR_0201  [0201]
R37961  10K  RESISTOR_0201  [0201]
R37962  10K  RESISTOR_0201  [0201]
R37963  10K  RESISTOR_0201  [0201]
R37964  10K  RESISTOR_0201  [0201]
R37965  10K  RESISTOR_0201  [0201]
R37966  10K  RESISTOR_0201  [0201]
R37967  10K  RESISTOR_0201  [0201]
R37968  10K  RESISTOR_0201  [0201]
R37969  10K  RESISTOR_0201  [0201]
R37970  10K  RESISTOR_0201  [0201]
R37971  10K  RESISTOR_0201  [0201]
R37972  10K  RESISTOR_0201  [0201]
R37973  10K  RESISTOR_0201  [0201]
R37974  10K  RESISTOR_0201  [0201]
R37975  10K  RESISTOR_0201  [0201]
R37976  10K  RESISTOR_0201  [0201]
R37977  10K  RESISTOR_0201  [0201]
R37978  10K  RESISTOR_0201  [0201]
R37979  10K  RESISTOR_0201  [0201]
R37980  10K  RESISTOR_0201  [0201]
R37981  10K  RESISTOR_0201  [0201]
R37982  10K  RESISTOR_0201  [0201]
R37983  10K  RESISTOR_0201  [0201]
R37984  10K  RESISTOR_0201  [0201]
R37985  10K  RESISTOR_0201  [0201]
R37986  10K  RESISTOR_0201  [0201]
R37987  10K  RESISTOR_0201  [0201]
R37988  10K  RESISTOR_0201  [0201]
R37989  10K  RESISTOR_0201  [0201]
R37990  10K  RESISTOR_0201  [0201]
R37991  10K  RESISTOR_0201  [0201]
R37992  10K  RESISTOR_0201  [0201]
R37993  10K  RESISTOR_0201  [0201]
R37994  10K  RESISTOR_0201  [0201]
R37995  10K  RESISTOR_0201  [0201]
R37996  10K  RESISTOR_0201  [0201]
R37997  10K  RESISTOR_0201  [0201]
R37998  10K  RESISTOR_0201  [0201]
R37999  10K  RESISTOR_0201  [0201]
R38000  10K  RESISTOR_0201  [0201]
R38001  10K  RESISTOR_0201  [0201]
R38002  10K  RESISTOR_0201  [0201]
R38003  10K  RESISTOR_0201  [0201]
R38004  10K  RESISTOR_0201  [0201]
R38005  10K  RESISTOR_0201  [0201]
R38006  10K  RESISTOR_0201  [0201]
R38007  10K  RESISTOR_0201  [0201]
R38008  10K  RESISTOR_0201  [0201]
R38009  10K  RESISTOR_0201  [0201]
R38010  10K  RESISTOR_0201  [0201]
R38011  10K  RESISTOR_0201  [0201]
R38012  10K  RESISTOR_0201  [0201]
R38013  10K  RESISTOR_0201  [0201]
R38014  10K  RESISTOR_0201  [0201]
R38015  10K  RESISTOR_0201  [0201]
R38016  10K  RESISTOR_0201  [0201]
R38017  10K  RESISTOR_0201  [0201]
R38018  10K  RESISTOR_0201  [0201]
R38019  10K  RESISTOR_0201  [0201]
R38020  10K  RESISTOR_0201  [0201]
R38021  10K  RESISTOR_0201  [0201]
R38022  10K  RESISTOR_0201  [0201]
R38023  10K  RESISTOR_0201  [0201]
R38024  10K  RESISTOR_0201  [0201]
R38025  10K  RESISTOR_0201  [0201]
R38026  10K  RESISTOR_0201  [0201]
R38027  10K  RESISTOR_0201  [0201]
R38028  10K  RESISTOR_0201  [0201]
R38029  10K  RESISTOR_0201  [0201]
R38030  10K  RESISTOR_0201  [0201]
R38031  10K  RESISTOR_0201  [0201]
R38032  10K  RESISTOR_0201  [0201]
R38033  10K  RESISTOR_0201  [0201]
R38034  10K  RESISTOR_0201  [0201]
R38035  10K  RESISTOR_0201  [0201]
R38036  10K  RESISTOR_0201  [0201]
R38037  10K  RESISTOR_0201  [0201]
R38038  10K  RESISTOR_0201  [0201]
R38039  10K  RESISTOR_0201  [0201]
R38040  10K  RESISTOR_0201  [0201]
R38041  10K  RESISTOR_0201  [0201]
R38042  10K  RESISTOR_0201  [0201]
R38043  10K  RESISTOR_0201  [0201]
R38044  10K  RESISTOR_0201  [0201]
R38045  10K  RESISTOR_0201  [0201]
R38046  10K  RESISTOR_0201  [0201]
R38047  10K  RESISTOR_0201  [0201]
R38048  10K  RESISTOR_0201  [0201]
R38049  10K  RESISTOR_0201  [0201]
R38050  10K  RESISTOR_0201  [0201]
R38051  10K  RESISTOR_0201  [0201]
R38052  10K  RESISTOR_0201  [0201]
R38053  10K  RESISTOR_0201  [0201]
R38054  10K  RESISTOR_0201  [0201]
R38055  10K  RESISTOR_0201  [0201]
R38056  10K  RESISTOR_0201  [0201]
R38057  10K  RESISTOR_0201  [0201]
R38058  10K  RESISTOR_0201  [0201]
R38059  10K  RESISTOR_0201  [0201]
R38060  10K  RESISTOR_0201  [0201]
R38061  10K  RESISTOR_0201  [0201]
R38062  10K  RESISTOR_0201  [0201]
R38063  10K  RESISTOR_0201  [0201]
R38064  10K  RESISTOR_0201  [0201]
R38065  10K  RESISTOR_0201  [0201]
R38066  10K  RESISTOR_0201  [0201]
R38067  10K  RESISTOR_0201  [0201]
R38068  10K  RESISTOR_0201  [0201]
R38069  10K  RESISTOR_0201  [0201]
R38070  10K  RESISTOR_0201  [0201]
R38071  10K  RESISTOR_0201  [0201]
R38072  10K  RESISTOR_0201  [0201]
R38073  10K  RESISTOR_0201  [0201]
R38074  10K  RESISTOR_0201  [0201]
R38075  10K  RESISTOR_0201  [0201]
R38076  10K  RESISTOR_0201  [0201]
R38077  10K  RESISTOR_0201  [0201]
R38078  10K  RESISTOR_0201  [0201]
R38079  10K  RESISTOR_0201  [0201]
R38080  10K  RESISTOR_0201  [0201]
R38081  10K  RESISTOR_0201  [0201]
R38082  10K  RESISTOR_0201  [0201]
R38083  10K  RESISTOR_0201  [0201]
R38084  10K  RESISTOR_0201  [0201]
R38085  10K  RESISTOR_0201  [0201]
R38086  10K  RESISTOR_0201  [0201]
R38087  10K  RESISTOR_0201  [0201]
R38088  10K  RESISTOR_0201  [0201]
R38089  10K  RESISTOR_0201  [0201]
R38090  10K  RESISTOR_0201  [0201]
R38091  10K  RESISTOR_0201  [0201]
R38092  10K  RESISTOR_0201  [0201]
R38093  10K  RESISTOR_0201  [0201]
R38094  10K  RESISTOR_0201  [0201]
R38095  10K  RESISTOR_0201  [0201]
R38096  10K  RESISTOR_0201  [0201]
R38097  10K  RESISTOR_0201  [0201]
R38098  10K  RESISTOR_0201  [0201]
R38099  10K  RESISTOR_0201  [0201]
R38100  10K  RESISTOR_0201  [0201]
R38101  10K  RESISTOR_0201  [0201]
R38102  10K  RESISTOR_0201  [0201]
R38103  10K  RESISTOR_0201  [0201]
R38104  10K  RESISTOR_0201  [0201]
R38105  10K  RESISTOR_0201  [0201]
R38106  10K  RESISTOR_0201  [0201]
R38107  10K  RESISTOR_0201  [0201]
R38108  10K  RESISTOR_0201  [0201]
R38109  10K  RESISTOR_0201  [0201]
R38110  10K  RESISTOR_0201  [0201]
R38111  10K  RESISTOR_0201  [0201]
R38112  10K  RESISTOR_0201  [0201]
R38113  10K  RESISTOR_0201  [0201]
R38114  10K  RESISTOR_0201  [0201]
R38115  10K  RESISTOR_0201  [0201]
R38116  10K  RESISTOR_0201  [0201]
R38117  10K  RESISTOR_0201  [0201]
R38118  10K  RESISTOR_0201  [0201]
R38119  10K  RESISTOR_0201  [0201]
R38120  10K  RESISTOR_0201  [0201]
R38121  10K  RESISTOR_0201  [0201]
R38122  10K  RESISTOR_0201  [0201]
R38123  10K  RESISTOR_0201  [0201]
R38124  10K  RESISTOR_0201  [0201]
R38125  10K  RESISTOR_0201  [0201]
R38126  10K  RESISTOR_0201  [0201]
R38127  10K  RESISTOR_0201  [0201]
R38128  10K  RESISTOR_0201  [0201]
R38129  10K  RESISTOR_0201  [0201]
R38130  10K  RESISTOR_0201  [0201]
R38131  10K  RESISTOR_0201  [0201]
R38132  10K  RESISTOR_0201  [0201]
R38133  10K  RESISTOR_0201  [0201]
R38134  10K  RESISTOR_0201  [0201]
R38135  10K  RESISTOR_0201  [0201]
R38136  10K  RESISTOR_0201  [0201]
R38137  10K  RESISTOR_0201  [0201]
R38138  10K  RESISTOR_0201  [0201]
R38139  10K  RESISTOR_0201  [0201]
R38140  10K  RESISTOR_0201  [0201]
R38141  10K  RESISTOR_0201  [0201]
R38142  10K  RESISTOR_0201  [0201]
R38143  10K  RESISTOR_0201  [0201]
R38144  10K  RESISTOR_0201  [0201]
R38145  10K  RESISTOR_0201  [0201]
R38146  10K  RESISTOR_0201  [0201]
R38147  10K  RESISTOR_0201  [0201]
R38148  10K  RESISTOR_0201  [0201]
R38149  10K  RESISTOR_0201  [0201]
R38150  10K  RESISTOR_0201  [0201]
R38151  10K  RESISTOR_0201  [0201]
R38152  10K  RESISTOR_0201  [0201]
R38153  10K  RESISTOR_0201  [0201]
R38154  10K  RESISTOR_0201  [0201]
R38155  10K  RESISTOR_0201  [0201]
R38156  10K  RESISTOR_0201  [0201]
R38157  10K  RESISTOR_0201  [0201]
R38158  10K  RESISTOR_0201  [0201]
R38159  10K  RESISTOR_0201  [0201]
R38160  10K  RESISTOR_0201  [0201]
R38161  10K  RESISTOR_0201  [0201]
R38162  10K  RESISTOR_0201  [0201]
R38163  10K  RESISTOR_0201  [0201]
R38164  10K  RESISTOR_0201  [0201]
R38165  10K  RESISTOR_0201  [0201]
R38166  10K  RESISTOR_0201  [0201]
R38167  10K  RESISTOR_0201  [0201]
R38168  10K  RESISTOR_0201  [0201]
R38169  10K  RESISTOR_0201  [0201]
R38170  10K  RESISTOR_0201  [0201]
R38171  10K  RESISTOR_0201  [0201]
R38172  10K  RESISTOR_0201  [0201]
R38173  10K  RESISTOR_0201  [0201]
R38174  10K  RESISTOR_0201  [0201]
R38175  10K  RESISTOR_0201  [0201]
R38176  10K  RESISTOR_0201  [0201]
R38177  10K  RESISTOR_0201  [0201]
R38178  10K  RESISTOR_0201  [0201]
R38179  10K  RESISTOR_0201  [0201]
R38180  10K  RESISTOR_0201  [0201]
R38181  10K  RESISTOR_0201  [0201]
R38182  10K  RESISTOR_0201  [0201]
R38183  10K  RESISTOR_0201  [0201]
R38184  10K  RESISTOR_0201  [0201]
R38185  10K  RESISTOR_0201  [0201]
R38186  10K  RESISTOR_0201  [0201]
R38187  10K  RESISTOR_0201  [0201]
R38188  10K  RESISTOR_0201  [0201]
R38189  10K  RESISTOR_0201  [0201]
R38190  10K  RESISTOR_0201  [0201]
R38191  10K  RESISTOR_0201  [0201]
R38192  10K  RESISTOR_0201  [0201]
R38193  10K  RESISTOR_0201  [0201]
R38194  10K  RESISTOR_0201  [0201]
R38195  10K  RESISTOR_0201  [0201]
R38196  10K  RESISTOR_0201  [0201]
R38197  10K  RESISTOR_0201  [0201]
R38198  10K  RESISTOR_0201  [0201]
R38199  10K  RESISTOR_0201  [0201]
R38200  10K  RESISTOR_0201  [0201]
R38201  10K  RESISTOR_0201  [0201]
R38202  10K  RESISTOR_0201  [0201]
R38203  10K  RESISTOR_0201  [0201]
R38204  10K  RESISTOR_0201  [0201]
R38205  10K  RESISTOR_0201  [0201]
R38206  10K  RESISTOR_0201  [0201]
R38207  10K  RESISTOR_0201  [0201]
R38208  10K  RESISTOR_0201  [0201]
R38209  10K  RESISTOR_0201  [0201]
R38210  10K  RESISTOR_0201  [0201]
R38211  10K  RESISTOR_0201  [0201]
R38212  10K  RESISTOR_0201  [0201]
R38213  10K  RESISTOR_0201  [0201]
R38214  10K  RESISTOR_0201  [0201]
R38215  10K  RESISTOR_0201  [0201]
R38216  10K  RESISTOR_0201  [0201]
R38217  10K  RESISTOR_0201  [0201]
R38218  10K  RESISTOR_0201  [0201]
R38219  10K  RESISTOR_0201  [0201]
R38220  10K  RESISTOR_0201  [0201]
R38221  10K  RESISTOR_0201  [0201]
R38222  10K  RESISTOR_0201  [0201]
R38223  10K  RESISTOR_0201  [0201]
R38224  10K  RESISTOR_0201  [0201]
R38225  10K  RESISTOR_0201  [0201]
R38226  10K  RESISTOR_0201  [0201]
R38227  10K  RESISTOR_0201  [0201]
R38228  10K  RESISTOR_0201  [0201]
R38229  10K  RESISTOR_0201  [0201]
R38230  10K  RESISTOR_0201  [0201]
R38231  10K  RESISTOR_0201  [0201]
R38232  10K  RESISTOR_0201  [0201]
R38233  10K  RESISTOR_0201  [0201]
R38234  10K  RESISTOR_0201  [0201]
R38235  10K  RESISTOR_0201  [0201]
R38236  10K  RESISTOR_0201  [0201]
R38237  10K  RESISTOR_0201  [0201]
R38238  10K  RESISTOR_0201  [0201]
R38239  10K  RESISTOR_0201  [0201]
R38240  10K  RESISTOR_0201  [0201]
R38241  10K  RESISTOR_0201  [0201]
R38242  10K  RESISTOR_0201  [0201]
R38243  10K  RESISTOR_0201  [0201]
R38244  10K  RESISTOR_0201  [0201]
R38245  10K  RESISTOR_0201  [0201]
R38246  10K  RESISTOR_0201  [0201]
R38247  10K  RESISTOR_0201  [0201]
R38248  10K  RESISTOR_0201  [0201]
R38249  10K  RESISTOR_0201  [0201]
R38250  10K  RESISTOR_0201  [0201]
R38251  10K  RESISTOR_0201  [0201]
R38252  10K  RESISTOR_0201  [0201]
R38253  10K  RESISTOR_0201  [0201]
R38254  10K  RESISTOR_0201  [0201]
R38255  10K  RESISTOR_0201  [0201]
R38256  10K  RESISTOR_0201  [0201]
R38257  10K  RESISTOR_0201  [0201]
R38258  10K  RESISTOR_0201  [0201]
R38259  10K  RESISTOR_0201  [0201]
R38260  10K  RESISTOR_0201  [0201]
R38261  10K  RESISTOR_0201  [0201]
R38262  10K  RESISTOR_0201  [0201]
R38263  10K  RESISTOR_0201  [0201]
R38264  10K  RESISTOR_0201  [0201]
R38265  10K  RESISTOR_0201  [0201]
R38266  10K  RESISTOR_0201  [0201]
R38267  10K  RESISTOR_0201  [0201]
R38268  10K  RESISTOR_0201  [0201]
R38269  10K  RESISTOR_0201  [0201]
R38270  10K  RESISTOR_0201  [0201]
R38271  10K  RESISTOR_0201  [0201]
R38272  10K  RESISTOR_0201  [0201]
R38273  10K  RESISTOR_0201  [0201]
R38274  10K  RESISTOR_0201  [0201]
R38275  10K  RESISTOR_0201  [0201]
R38276  10K  RESISTOR_0201  [0201]
R38277  10K  RESISTOR_0201  [0201]
R38278  10K  RESISTOR_0201  [0201]
R38279  10K  RESISTOR_0201  [0201]
R38280  10K  RESISTOR_0201  [0201]
R38281  10K  RESISTOR_0201  [0201]
R38282  10K  RESISTOR_0201  [0201]
R38283  10K  RESISTOR_0201  [0201]
R38284  10K  RESISTOR_0201  [0201]
R38285  10K  RESISTOR_0201  [0201]
R38286  10K  RESISTOR_0201  [0201]
R38287  10K  RESISTOR_0201  [0201]
R38288  10K  RESISTOR_0201  [0201]
R38289  10K  RESISTOR_0201  [0201]
R38290  10K  RESISTOR_0201  [0201]
R38291  10K  RESISTOR_0201  [0201]
R38292  10K  RESISTOR_0201  [0201]
R38293  10K  RESISTOR_0201  [0201]
R38294  10K  RESISTOR_0201  [0201]
R38295  10K  RESISTOR_0201  [0201]
R38296  10K  RESISTOR_0201  [0201]
R38297  10K  RESISTOR_0201  [0201]
R38298  10K  RESISTOR_0201  [0201]
R38299  10K  RESISTOR_0201  [0201]
R38300  10K  RESISTOR_0201  [0201]
R38301  10K  RESISTOR_0201  [0201]
R38302  10K  RESISTOR_0201  [0201]
R38303  10K  RESISTOR_0201  [0201]
R38304  10K  RESISTOR_0201  [0201]
R38305  10K  RESISTOR_0201  [0201]
R38306  10K  RESISTOR_0201  [0201]
R38307  10K  RESISTOR_0201  [0201]
R38308  10K  RESISTOR_0201  [0201]
R38309  10K  RESISTOR_0201  [0201]
R38310  10K  RESISTOR_0201  [0201]
R38311  10K  RESISTOR_0201  [0201]
R38312  10K  RESISTOR_0201  [0201]
R38313  10K  RESISTOR_0201  [0201]
R38314  10K  RESISTOR_0201  [0201]
R38315  10K  RESISTOR_0201  [0201]
R38316  10K  RESISTOR_0201  [0201]
R38317  10K  RESISTOR_0201  [0201]
R38318  10K  RESISTOR_0201  [0201]
R38319  10K  RESISTOR_0201  [0201]
R38320  10K  RESISTOR_0201  [0201]
R38321  10K  RESISTOR_0201  [0201]
R38322  10K  RESISTOR_0201  [0201]
R38323  10K  RESISTOR_0201  [0201]
R38324  10K  RESISTOR_0201  [0201]
R38325  10K  RESISTOR_0201  [0201]
R38326  10K  RESISTOR_0201  [0201]
R38327  10K  RESISTOR_0201  [0201]
R38328  10K  RESISTOR_0201  [0201]
R38329  10K  RESISTOR_0201  [0201]
R38330  10K  RESISTOR_0201  [0201]
R38331  10K  RESISTOR_0201  [0201]
R38332  10K  RESISTOR_0201  [0201]
R38333  10K  RESISTOR_0201  [0201]
R38334  10K  RESISTOR_0201  [0201]
R38335  10K  RESISTOR_0201  [0201]
R38336  10K  RESISTOR_0201  [0201]
R38337  10K  RESISTOR_0201  [0201]
R38338  10K  RESISTOR_0201  [0201]
R38339  10K  RESISTOR_0201  [0201]
R38340  10K  RESISTOR_0201  [0201]
R38341  10K  RESISTOR_0201  [0201]
R38342  10K  RESISTOR_0201  [0201]
R38343  10K  RESISTOR_0201  [0201]
R38344  10K  RESISTOR_0201  [0201]
R38345  10K  RESISTOR_0201  [0201]
R38346  10K  RESISTOR_0201  [0201]
R38347  10K  RESISTOR_0201  [0201]
R38348  10K  RESISTOR_0201  [0201]
R38349  10K  RESISTOR_0201  [0201]
R38350  10K  RESISTOR_0201  [0201]
R38351  10K  RESISTOR_0201  [0201]
R38352  10K  RESISTOR_0201  [0201]
R38353  10K  RESISTOR_0201  [0201]
R38354  10K  RESISTOR_0201  [0201]
R38355  10K  RESISTOR_0201  [0201]
R38356  10K  RESISTOR_0201  [0201]
R38357  10K  RESISTOR_0201  [0201]
R38358  10K  RESISTOR_0201  [0201]
R38359  10K  RESISTOR_0201  [0201]
R38360  10K  RESISTOR_0201  [0201]
R38361  10K  RESISTOR_0201  [0201]
R38362  10K  RESISTOR_0201  [0201]
R38363  10K  RESISTOR_0201  [0201]
R38364  10K  RESISTOR_0201  [0201]
R38365  10K  RESISTOR_0201  [0201]
R38366  10K  RESISTOR_0201  [0201]
R38367  10K  RESISTOR_0201  [0201]
R38368  10K  RESISTOR_0201  [0201]
R38369  10K  RESISTOR_0201  [0201]
R38370  10K  RESISTOR_0201  [0201]
R38371  10K  RESISTOR_0201  [0201]
R38372  10K  RESISTOR_0201  [0201]
R38373  10K  RESISTOR_0201  [0201]
R38374  10K  RESISTOR_0201  [0201]
R38375  10K  RESISTOR_0201  [0201]
R38376  10K  RESISTOR_0201  [0201]
R38377  10K  RESISTOR_0201  [0201]
R38378  10K  RESISTOR_0201  [0201]
R38379  10K  RESISTOR_0201  [0201]
R38380  10K  RESISTOR_0201  [0201]
R38381  10K  RESISTOR_0201  [0201]
R38382  10K  RESISTOR_0201  [0201]
R38383  10K  RESISTOR_0201  [0201]
R38384  10K  RESISTOR_0201  [0201]
R38385  10K  RESISTOR_0201  [0201]
R38386  10K  RESISTOR_0201  [0201]
R38387  10K  RESISTOR_0201  [0201]
R38388  10K  RESISTOR_0201  [0201]
R38389  10K  RESISTOR_0201  [0201]
R38390  10K  RESISTOR_0201  [0201]
R38391  10K  RESISTOR_0201  [0201]
R38392  10K  RESISTOR_0201  [0201]
R38393  10K  RESISTOR_0201  [0201]
R38394  10K  RESISTOR_0201  [0201]
R38395  10K  RESISTOR_0201  [0201]
R38396  10K  RESISTOR_0201  [0201]
R38397  10K  RESISTOR_0201  [0201]
R38398  10K  RESISTOR_0201  [0201]
R38399  10K  RESISTOR_0201  [0201]
R38400  10K  RESISTOR_0201  [0201]
R38401  10K  RESISTOR_0201  [0201]
R38402  10K  RESISTOR_0201  [0201]
R38403  10K  RESISTOR_0201  [0201]
R38404  10K  RESISTOR_0201  [0201]
R38405  10K  RESISTOR_0201  [0201]
R38406  10K  RESISTOR_0201  [0201]
R38407  10K  RESISTOR_0201  [0201]
R38408  10K  RESISTOR_0201  [0201]
R38409  10K  RESISTOR_0201  [0201]
R38410  10K  RESISTOR_0201  [0201]
R38411  10K  RESISTOR_0201  [0201]
R38412  10K  RESISTOR_0201  [0201]
R38413  10K  RESISTOR_0201  [0201]
R38414  10K  RESISTOR_0201  [0201]
R38415  10K  RESISTOR_0201  [0201]
R38416  10K  RESISTOR_0201  [0201]
R38417  10K  RESISTOR_0201  [0201]
R38418  10K  RESISTOR_0201  [0201]
R38419  10K  RESISTOR_0201  [0201]
R38420  10K  RESISTOR_0201  [0201]
R38421  10K  RESISTOR_0201  [0201]
R38422  10K  RESISTOR_0201  [0201]
R38423  10K  RESISTOR_0201  [0201]
R38424  10K  RESISTOR_0201  [0201]
R38425  10K  RESISTOR_0201  [0201]
R38426  10K  RESISTOR_0201  [0201]
R38427  10K  RESISTOR_0201  [0201]
R38428  10K  RESISTOR_0201  [0201]
R38429  10K  RESISTOR_0201  [0201]
R38430  10K  RESISTOR_0201  [0201]
R38431  10K  RESISTOR_0201  [0201]
R38432  10K  RESISTOR_0201  [0201]
R38433  10K  RESISTOR_0201  [0201]
R38434  10K  RESISTOR_0201  [0201]
R38435  10K  RESISTOR_0201  [0201]
R38436  10K  RESISTOR_0201  [0201]
R38437  10K  RESISTOR_0201  [0201]
R38438  10K  RESISTOR_0201  [0201]
R38439  10K  RESISTOR_0201  [0201]
R38440  10K  RESISTOR_0201  [0201]
R38441  10K  RESISTOR_0201  [0201]
R38442  10K  RESISTOR_0201  [0201]
R38443  10K  RESISTOR_0201  [0201]
R38444  10K  RESISTOR_0201  [0201]
R38445  10K  RESISTOR_0201  [0201]
R38446  10K  RESISTOR_0201  [0201]
R38447  10K  RESISTOR_0201  [0201]
R38448  10K  RESISTOR_0201  [0201]
R38449  10K  RESISTOR_0201  [0201]
R38450  10K  RESISTOR_0201  [0201]
R38451  10K  RESISTOR_0201  [0201]
R38452  10K  RESISTOR_0201  [0201]
R38453  10K  RESISTOR_0201  [0201]
R38454  10K  RESISTOR_0201  [0201]
R38455  10K  RESISTOR_0201  [0201]
R38456  10K  RESISTOR_0201  [0201]
R38457  10K  RESISTOR_0201  [0201]
R38458  10K  RESISTOR_0201  [0201]
R38459  10K  RESISTOR_0201  [0201]
R38460  10K  RESISTOR_0201  [0201]
R38461  10K  RESISTOR_0201  [0201]
R38462  10K  RESISTOR_0201  [0201]
R38463  10K  RESISTOR_0201  [0201]
R38464  10K  RESISTOR_0201  [0201]
R38465  10K  RESISTOR_0201  [0201]
R38466  10K  RESISTOR_0201  [0201]
R38467  10K  RESISTOR_0201  [0201]
R38468  10K  RESISTOR_0201  [0201]
R38469  10K  RESISTOR_0201  [0201]
R38470  10K  RESISTOR_0201  [0201]
R38471  10K  RESISTOR_0201  [0201]
R38472  10K  RESISTOR_0201  [0201]
R38473  10K  RESISTOR_0201  [0201]
R38474  10K  RESISTOR_0201  [0201]
R38475  10K  RESISTOR_0201  [0201]
R38476  10K  RESISTOR_0201  [0201]
R38477  10K  RESISTOR_0201  [0201]
R38478  10K  RESISTOR_0201  [0201]
R38479  10K  RESISTOR_0201  [0201]
R38480  10K  RESISTOR_0201  [0201]
R38481  10K  RESISTOR_0201  [0201]
R38482  10K  RESISTOR_0201  [0201]
R38483  10K  RESISTOR_0201  [0201]
R38484  10K  RESISTOR_0201  [0201]
R38485  10K  RESISTOR_0201  [0201]
R38486  10K  RESISTOR_0201  [0201]
R38487  10K  RESISTOR_0201  [0201]
R38488  10K  RESISTOR_0201  [0201]
R38489  10K  RESISTOR_0201  [0201]
R38490  10K  RESISTOR_0201  [0201]
R38491  10K  RESISTOR_0201  [0201]
R38492  10K  RESISTOR_0201  [0201]
R38493  10K  RESISTOR_0201  [0201]
R38494  10K  RESISTOR_0201  [0201]
R38495  10K  RESISTOR_0201  [0201]
R38496  10K  RESISTOR_0201  [0201]
R38497  10K  RESISTOR_0201  [0201]
R38498  10K  RESISTOR_0201  [0201]
R38499  10K  RESISTOR_0201  [0201]
R38500  10K  RESISTOR_0201  [0201]
R38501  10K  RESISTOR_0201  [0201]
R38502  10K  RESISTOR_0201  [0201]
R38503  10K  RESISTOR_0201  [0201]
R38504  10K  RESISTOR_0201  [0201]
R38505  10K  RESISTOR_0201  [0201]
R38506  10K  RESISTOR_0201  [0201]
R38507  10K  RESISTOR_0201  [0201]
R38508  10K  RESISTOR_0201  [0201]
R38509  10K  RESISTOR_0201  [0201]
R38510  10K  RESISTOR_0201  [0201]
R38511  10K  RESISTOR_0201  [0201]
R38512  10K  RESISTOR_0201  [0201]
R38513  10K  RESISTOR_0201  [0201]
R38514  10K  RESISTOR_0201  [0201]
R38515  10K  RESISTOR_0201  [0201]
R38516  10K  RESISTOR_0201  [0201]
R38517  10K  RESISTOR_0201  [0201]
R38518  10K  RESISTOR_0201  [0201]
R38519  10K  RESISTOR_0201  [0201]
R38520  10K  RESISTOR_0201  [0201]
R38521  10K  RESISTOR_0201  [0201]
R38522  10K  RESISTOR_0201  [0201]
R38523  10K  RESISTOR_0201  [0201]
R38524  10K  RESISTOR_0201  [0201]
R38525  10K  RESISTOR_0201  [0201]
R38526  10K  RESISTOR_0201  [0201]
R38527  10K  RESISTOR_0201  [0201]
R38528  10K  RESISTOR_0201  [0201]
R38529  10K  RESISTOR_0201  [0201]
R38530  10K  RESISTOR_0201  [0201]
R38531  10K  RESISTOR_0201  [0201]
R38532  10K  RESISTOR_0201  [0201]
R38533  10K  RESISTOR_0201  [0201]
R38534  10K  RESISTOR_0201  [0201]
R38535  10K  RESISTOR_0201  [0201]
R38536  10K  RESISTOR_0201  [0201]
R38537  10K  RESISTOR_0201  [0201]
R38538  10K  RESISTOR_0201  [0201]
R38539  10K  RESISTOR_0201  [0201]
R38540  10K  RESISTOR_0201  [0201]
R38541  10K  RESISTOR_0201  [0201]
R38542  10K  RESISTOR_0201  [0201]
R38543  10K  RESISTOR_0201  [0201]
R38544  10K  RESISTOR_0201  [0201]
R38545  10K  RESISTOR_0201  [0201]
R38546  10K  RESISTOR_0201  [0201]
R38547  10K  RESISTOR_0201  [0201]
R38548  10K  RESISTOR_0201  [0201]
R38549  10K  RESISTOR_0201  [0201]
R38550  10K  RESISTOR_0201  [0201]
R38551  10K  RESISTOR_0201  [0201]
R38552  10K  RESISTOR_0201  [0201]
R38553  10K  RESISTOR_0201  [0201]
R38554  10K  RESISTOR_0201  [0201]
R38555  10K  RESISTOR_0201  [0201]
R38556  10K  RESISTOR_0201  [0201]
R38557  10K  RESISTOR_0201  [0201]
R38558  10K  RESISTOR_0201  [0201]
R38559  10K  RESISTOR_0201  [0201]
R38560  10K  RESISTOR_0201  [0201]
R38561  10K  RESISTOR_0201  [0201]
R38562  10K  RESISTOR_0201  [0201]
R38563  10K  RESISTOR_0201  [0201]
R38564  10K  RESISTOR_0201  [0201]
R38565  10K  RESISTOR_0201  [0201]
R38566  10K  RESISTOR_0201  [0201]
R38567  10K  RESISTOR_0201  [0201]
R38568  10K  RESISTOR_0201  [0201]
R38569  10K  RESISTOR_0201  [0201]
R38570  10K  RESISTOR_0201  [0201]
R38571  10K  RESISTOR_0201  [0201]
R38572  10K  RESISTOR_0201  [0201]
R38573  10K  RESISTOR_0201  [0201]
R38574  10K  RESISTOR_0201  [0201]
R38575  10K  RESISTOR_0201  [0201]
R38576  10K  RESISTOR_0201  [0201]
R38577  10K  RESISTOR_0201  [0201]
R38578  10K  RESISTOR_0201  [0201]
R38579  10K  RESISTOR_0201  [0201]
R38580  10K  RESISTOR_0201  [0201]
R38581  10K  RESISTOR_0201  [0201]
R38582  10K  RESISTOR_0201  [0201]
R38583  10K  RESISTOR_0201  [0201]
R38584  10K  RESISTOR_0201  [0201]
R38585  10K  RESISTOR_0201  [0201]
R38586  10K  RESISTOR_0201  [0201]
R38587  10K  RESISTOR_0201  [0201]
R38588  10K  RESISTOR_0201  [0201]
R38589  10K  RESISTOR_0201  [0201]
R38590  10K  RESISTOR_0201  [0201]
R38591  10K  RESISTOR_0201  [0201]
R38592  10K  RESISTOR_0201  [0201]
R38593  10K  RESISTOR_0201  [0201]
R38594  10K  RESISTOR_0201  [0201]
R38595  10K  RESISTOR_0201  [0201]
R38596  10K  RESISTOR_0201  [0201]
R38597  10K  RESISTOR_0201  [0201]
R38598  10K  RESISTOR_0201  [0201]
R38599  10K  RESISTOR_0201  [0201]
R38600  10K  RESISTOR_0201  [0201]
R38601  10K  RESISTOR_0201  [0201]
R38602  10K  RESISTOR_0201  [0201]
R38603  10K  RESISTOR_0201  [0201]
R38604  10K  RESISTOR_0201  [0201]
R38605  10K  RESISTOR_0201  [0201]
R38606  10K  RESISTOR_0201  [0201]
R38607  10K  RESISTOR_0201  [0201]
R38608  10K  RESISTOR_0201  [0201]
R38609  10K  RESISTOR_0201  [0201]
R38610  10K  RESISTOR_0201  [0201]
R38611  10K  RESISTOR_0201  [0201]
R38612  10K  RESISTOR_0201  [0201]
R38613  10K  RESISTOR_0201  [0201]
R38614  10K  RESISTOR_0201  [0201]
R38615  10K  RESISTOR_0201  [0201]
R38616  10K  RESISTOR_0201  [0201]
R38617  10K  RESISTOR_0201  [0201]
R38618  10K  RESISTOR_0201  [0201]
R38619  10K  RESISTOR_0201  [0201]
R38620  10K  RESISTOR_0201  [0201]
R38621  10K  RESISTOR_0201  [0201]
R38622  10K  RESISTOR_0201  [0201]
R38623  10K  RESISTOR_0201  [0201]
R38624  10K  RESISTOR_0201  [0201]
R38625  10K  RESISTOR_0201  [0201]
R38626  10K  RESISTOR_0201  [0201]
R38627  10K  RESISTOR_0201  [0201]
R38628  10K  RESISTOR_0201  [0201]
R38629  10K  RESISTOR_0201  [0201]
R38630  10K  RESISTOR_0201  [0201]
R38631  10K  RESISTOR_0201  [0201]
R38632  10K  RESISTOR_0201  [0201]
R38633  10K  RESISTOR_0201  [0201]
R38634  10K  RESISTOR_0201  [0201]
R38635  10K  RESISTOR_0201  [0201]
R38636  10K  RESISTOR_0201  [0201]
R38637  10K  RESISTOR_0201  [0201]